# EasyEDA Pro project ZH_FLIGHT_H7B0.eprj, board PCB1
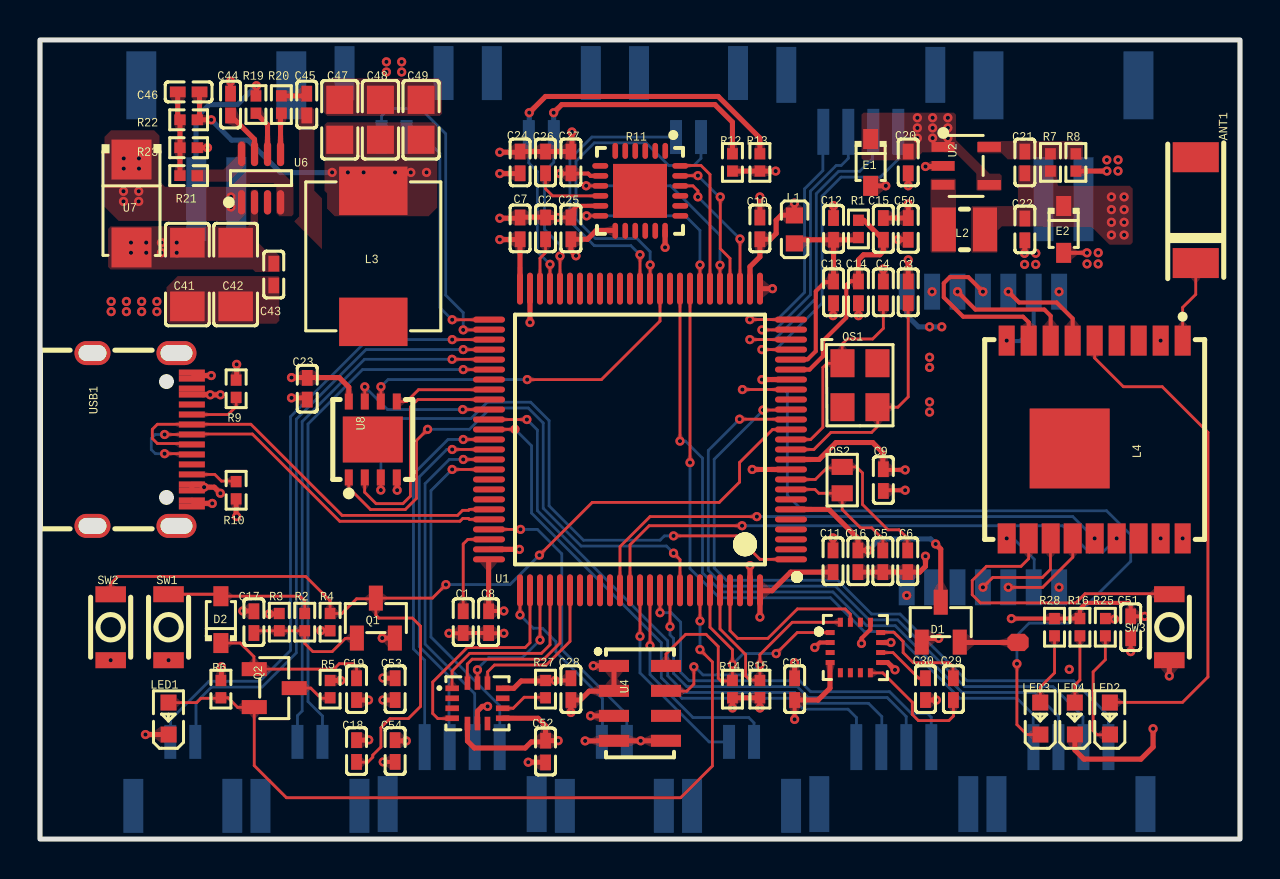
[diagram p4: board, top side]
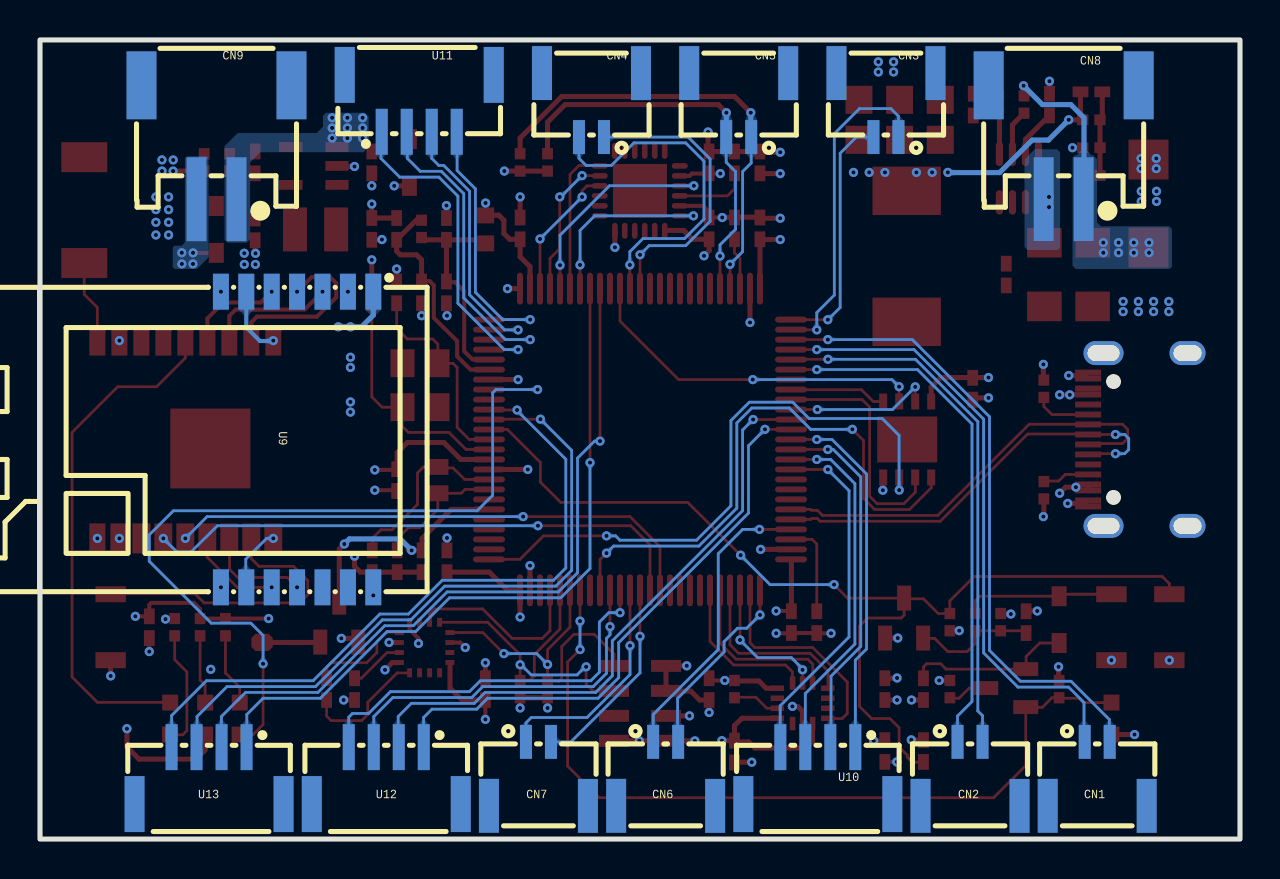
[diagram p5: board, bottom side, seen from below]

Outline 60 x 40 mm; copper layers: Top Layer, GND, PWR, Bottom Layer. Coordinates in mm from the lower left corner of the outline.
Outline path: rectangle 0,40 60,0
Stack: Top Layer 0.035mm / Dielectric1 0.48mm PP er 4.5 / GND 0.035mm / Dielectric2 0.48mm FR4 er 4.5 / PWR 0.035mm / Dielectric3 0.48mm PP er 4.5 / Bottom Layer 0.035mm

## Design rules (mm)
net VCC: PWR
net GND: PWR
net VDDA: PWR
net VREF: PWR
net VBAT: PWR
net VBAT_EXT: PWR
net +5V: PWR
net USB_D-: DP1
net USB_D+: DP1
net +12V: PWR
spacing safeClearance (default): track to track 0.152, other pairs 0.152 to 0.3
track width trackWidth (default): min 0.127, default 0.254, max 2.54
track width data: min 0.14, default 0.14, max 0.254
track width vcc: min 0.203, default 0.305, max 2.54
differential pair differentialPair (default): width min 0.127, default 0.254, max 2.54; gap min 0.152, default 0.152
via viaSize (default): diameter min 0.46, default 0.46, max 0.46; hole min 0.21, default 0.21, max 0.21
net class PWR uses vcc
net VCC uses vcc
net BOOT0 uses data
net $1N1678 uses data
net $1N1681 uses data
net 25M_OUT uses data
net 25M_IN uses data
net 32K_OUT uses data
net 32K_IN uses data
net GND uses vcc
net VDDA uses vcc
net VREF uses vcc
net RST uses data
net VBAT uses vcc
net VBAT_EXT uses vcc
net $1N8061 uses data
net $1N8406 uses data
net $1N8466 uses data
net $1N9525 uses data
net QSPI_BK1_NCS uses data
net QSPI_BK1_IO3 uses data
net QSPI_BK1_IO1 uses data
net QSPI_BK1_IO0 uses data
net QSPI_CLK uses data
net QSPI_BK1_IO2 uses data
net +5V uses vcc
net $1N12306 uses data
net $1N12347 uses data
net $1N18516 uses data
net USB_D- uses data
net USB_D+ uses data
net $1N18565 uses data
net $2N794 uses data
net IIC2_SDA uses data
net IIC2_SCL uses data
net $2N2599 uses data
net $2N2763 uses data
net $2N2588 uses data
net +12V uses vcc
net $3N1353 uses data
net $3N1354 uses data
net $3N1356 uses copperRegion1, data
net $3N1365 uses data
net $3N1361 uses data
net $3N1362 uses data
net $3N1363 uses data
net IIC1_SDA uses data
net IIC1_SCL uses data
net IIC1_EXIT uses data
net ELRS_NRST uses data
net ELRS_BUSY uses data
net ELRS_DIO1 uses data
net ELRS_RX uses data
net ELRS_TX uses data
net $4N1181 uses data
net ELRS_LED uses data
net $4N1470 uses data
net $4N1612 uses data
net ELRS_MOSI uses data
net ELRS_MISO uses data
net ELRS_NSS uses data
net ELRS_SCK uses data
net IMU2_CS uses data
net IMU2_MOSI uses data
net IMU2_MISO uses data
net IMU2_CLK uses data
net IMU2_EXIT uses data
net IMU1_EXIT uses data
net IMU1_MOSI uses data
net IMU1_MISO uses data
net IMU1_CLK uses data
net IMU1_CS uses data
net $2N4523 uses data
net PWM11 uses data
net PWM12 uses data
net EXTI3 uses data
net EXTI7 uses data
net SW_CLK uses data
net SW_DIO uses data
net PWM4 uses data
net PWM3 uses data
net PWM2 uses data
net PWM1 uses data
net PWM9 uses data
net PWM10 uses data
net UART3_RX uses data
net UART3_TX uses data
net UART1_RX uses data
net UART1_TX uses data
net UART5_TX uses data
net UART5_RX uses data
net UART7_TX uses data
net UART7_RX uses data
net ADC2_9 uses data
net ADC2_8 uses data
net PWM8 uses data
net PWM7 uses data
net PWM6 uses data
net PWM5 uses data
net ADC1_11 uses data
net ADC1_10 uses data

## Placement (name value [footprint] x y rotation side)
ANT1  CA-C03  [ANT-SMD_CA-C03]  57.79 31.48 270 top
C1  2.2uF  [C0402]  21.16 10.86 270 top
C2  2.2uF  [C0402]  25.28 30.57 270 top
C3  22pF  [C0402]  43.41 27.37 270 top
C4  22pF  [C0402]  42.17 27.37 270 top
C5  6pF  [C0402]  42.14 13.9 90 top
C6  6pF  [C0402]  43.39 13.9 90 top
C7  0.1uF  [C0402]  24.01 30.57 270 top
C8  0.1uF  [C0402]  22.43 10.86 90 top
C9  0.1uF  [C0402]  42.17 17.97 90 top
C10  0.1uF  [C0402]  35.99 30.57 270 top
C11  0.1uF  [C0402]  39.65 13.9 270 top
C12  10uF  [C0402]  39.68 30.54 270 top
C13  10uF  [C0402]  39.68 27.37 90 top
C14  10uF  [C0402]  40.92 27.37 90 top
C15  10uF  [C0402]  42.17 30.54 270 top
C16  0.1uF  [C0402]  40.9 13.9 90 top
C17  0.1uF  [C0402]  10.7 10.86 270 top
C18  0.1uF  [C0402]  15.83 4.41 270 top
C19  0.1uF  [C0402]  15.83 7.5 90 top
C20  10uF  [C0402]  43.41 33.87 90 top
C21  22pF  [C0402]  49.24 33.87 270 top
C22  10uF  [C0402]  49.24 30.52 90 top
C23  0.1uF  [C0402]  13.36 22.54 90 top
C24  0.1uF  [C0402]  24.01 33.87 270 top
C25  2.2uF  [C0402]  26.55 30.57 270 top
C26  0.47uF  [C0402]  25.28 33.87 270 top
C27  10nF  [C0402]  26.55 33.87 270 top
C28  0.1uF  [C0402]  26.55 7.5 270 top
C29  0.22uF  [C0402]  45.67 7.5 270 top
C30  4.7uF  [C0402]  44.27 7.5 270 top
C31  0.1uF  [C0402]  37.73 7.5 270 top
C41  N/A  [C1206]  7.37 28.26 90 top
C42  22uF  [C1206]  9.78 28.26 90 top
C43  0.1uF  [C0402]  11.69 28.26 90 top
C44  0.1uF  [C0402]  9.53 36.76 270 top
C45  0.1uF  [C0402]  13.34 36.76 270 top
C46  33pF  [C0402]  7.43 37.4 0 top
C47  22uF  [C0805]  14.99 36 270 top
C48  22uF  [C0805]  17.02 36 270 top
C49  N/A  [C0805]  19.05 36 270 top
C50  0.1uF  [C0402]  43.41 30.54 270 top
C51  0.1uF  [C0402]  54.53 10.6 270 top
C52  10nF  [C0402]  25.28 4.38 90 top
C53  0.1uF  [C0402]  17.76 7.5 270 top
C54  2.2uF  [C0402]  17.76 4.41 90 top
CN1  GH1.25-2PWBPZ  [CONN-SMD_GH1.25-2PWBPZ]  7.14 3.26 180 bottom
CN2  GH1.25-2PWBPZ  [CONN-SMD_GH1.25-2PWBPZ]  13.5 3.26 180 bottom
CN3  GH1.25-2PWBPZ  [CONN-SMD_GH1.25-2PWBPZ]  17.7 36.74 0 bottom
CN4  GH1.25-2PWBPZ  [CONN-SMD_GH1.25-2PWBPZ]  32.43 36.74 0 bottom
CN5  GH1.25-2PWBPZ  [CONN-SMD_GH1.25-2PWBPZ]  25.06 36.74 0 bottom
CN6  GH1.25-2PWBPZ  [CONN-SMD_GH1.25-2PWBPZ]  28.72 3.26 180 bottom
CN7  GH1.25-2PWBPZ  [CONN-SMD_GH1.25-2PWBPZ]  35.08 3.26 180 bottom
CN8  HDGC2001WR-S-2P  [CONN-SMD_2P-P2.00_HDGC_HDGC2001WR-S-2P]  8.82 34.88 0 bottom
CN9  HDGC2001WR-S-2P  [CONN-SMD_2P-P2.00_HDGC_HDGC2001WR-S-2P]  51.17 34.88 0 bottom
D1  BAT54C-KL3  [sot-23-3_l2.9-w1.3-p1.90-ls2.4-br]  45.04 10.86 270 top
D2  1N4148WS  [sod-323_l1.8-w1.3-ls2.5-rd]  9.04 10.98 90 top
E1  CESD5V0D3 ZA  [sod-323_l1.8-w1.3-ls2.5-rd]  41.53 33.87 270 top
E2  CESD3V3D3 YU  [sod-323_l1.8-w1.3-ls2.5-rd]  51.18 30.52 270 top
L1  SCBG160808U501T  [l0603]  37.72 30.52 270 top
L2  2.2uH  [ind-smd_l2.5-w2.0]  46.22 30.52 180 top
L3  4.7uH  [IND-SMD_L7.3-W6.6]  16.66 29.17 270 top
L4  ESP-01F-2M  [wifim-smd_esp-01f-2m]  52.73 20 270 top
LED1  -  [LED0603-RD_BLUE]  6.43 6.03 90 top
LED2  -  [LED0603-RD]  53.5 6.03 90 top
LED3  -  [LED0603-RD_BLUE]  50.01 6.03 90 top
LED4  -  [LED0603-RD]  51.74 6.03 90 top
NOREF  -  [Pad_e3197]  48.9 9.84 0 top
OS1  25MHz  [osc-smd_4p-l3.2-w2.5-bl]  41 22.72 270 top
OS2  32.768kHz  [osc-smd_2p-l1.6-w1.0]  40.11 17.97 270 top
Q1  SS8050  [sot-23-3_l2.9-w1.3-p1.90-ls2.4-br]  16.79 11.06 270 top
Q2  SS8050  [sot-23-3_l2.9-w1.3-p1.90-ls2.4-br]  11.71 7.55 180 top
R1  0R  [R0402]  40.92 30.54 270 top
R2  10K  [R0402]  13.24 10.86 270 top
R3  10K  [R0402]  11.97 10.86 270 top
R4  10K  [R0402]  14.51 10.86 270 top
R5  1K  [R0402]  14.51 7.5 90 top
R6  10K  [R0402]  9.04 7.5 270 top
R7  680K  [R0402]  50.52 33.87 270 top
R8  150K  [R0402]  51.79 33.87 90 top
R9  5.1K  [R0402]  9.81 22.54 90 top
R10  5.1K  [R0402]  9.81 17.46 90 top
R11  ICM-20689  [QFN-24_L4.0-W4.0-P0.50-TL-EP2.6]  30.01 32.45 270 top
R12  10K  [R0402]  34.62 33.87 90 top
R13  10K  [R0402]  35.99 33.87 90 top
R14  10K  [R0402]  34.62 7.5 90 top
R15  10K  [R0402]  35.99 7.5 90 top
R16  3K  [R0402]  52 10.6 270 top
R19  100K  [R0402]  10.8 36.77 270 top
R20  10R  [R0402]  12.07 36.76 90 top
R21  0R  [R0402]  7.43 33.21 180 top
R22  40.2K  [R0402]  7.43 36 0 top
R23  5.49K  [R0402]  7.43 34.61 180 top
R25  1K  [R0402]  53.27 10.6 90 top
R26  ICM-42688-P  [LGA-14_L3.0-W2.5-P0.50-TL]  21.87 6.8 0 top
R27  10K  [R0402]  25.28 7.5 90 top
R28  1K  [R0402]  50.73 10.6 270 top
SW1  K2-1827SQ-C3DW-06  [sw-smd_l3.0-w2.0-ls3.5]  6.43 10.6 90 top
SW2  K2-1827SQ-C3DW-06  [sw-smd_l3.0-w2.0-ls3.5]  3.53 10.6 270 top
SW3  K2-1827SQ-C3DW-06  [sw-smd_l3.0-w2.0-ls3.5]  56.47 10.6 270 top
U1  STM32H7B0VBT6  [lqfp-100_l14.0-w14.0-p0.50-ls16.0-bl]  30 20 90 top
U2  XT3410AFMR-G  [sot-23-5_l3.0-w1.7-p0.95-ls2.8-bl]  46.31 33.69 270 top
U4  MS5611-01BA03  [SENSORS-SMD_MS5611-01BA03]  30 6.79 270 top
U5  QMC5883L  [LGA-16_L3.0-W3.0-P0.50-BL_SQ]  40.77 9.59 270 top
U6  MP2225GJ  [TSOT-23-8_L2.9-W1.6-P0.65-LS2.8-BR]  11.05 33.08 270 top
U7  SMAJ12A  [SMA_L4.3-W2.6-LS5.2-RD]  4.57 31.81 270 top
U8  W25Q64JVXGIQ  [XSON-8_L4.0-W4.0-P0.80-TL-EP]  16.64 20 90 top
U9  E28-2G4M12S  [WIRELM-SMD_E28-2G4M12S]  47.15 20 270 bottom
U10  GH1.25-4PLTPZ  [CONN-SMD_4P-P1.25_GH1.25-4P]  21.11 3.17 180 bottom
U11  GH1.25-4PLTPZ  [CONN-SMD_4P-P1.25_GH1.25-4P]  41.04 36.83 0 bottom
U12  GH1.25-4PLTPZ  [CONN-SMD_4P-P1.25_GH1.25-4P]  42.69 3.17 180 bottom
U13  GH1.25-4PLTPZ  [CONN-SMD_4P-P1.25_GH1.25-4P]  51.55 3.17 180 bottom
USB1  TYPEC-304A-ACP16W  [usb-c_smd-type-c-31-m-12]  5.11 20 270 top

## Footprints (pads in the part's own frame, mm; a bottom-side part is the same pattern mirrored in y, then rotated)
ANT-SMD_CA-C03
  rect 1.501x2.301 smd: 1(-2.649,0) 2(2.649,0)
C0402
  rect 0.79x0.54 smd: 1(-0.545,0) 2(0.545,0)
C0805
  rect 1.41x1.35 smd: 1(-1,0) 2(1,0)
C1206
  rect 1.485x1.728 smd: 1(-1.593,0) 2(1.593,0)
CONN-SMD_2P-P2.00_HDGC_HDGC2001WR-S-2P
  rect 1x4.2 smd: 1(-1,2.85) 2(1,2.85)
  rect 1.5x3.4 smd: 3(3.75,-2.85) 4(-3.75,-2.85)
CONN-SMD_4P-P1.25_GH1.25-4P
  rect 0.6x2.3 smd: 1(1.875,1.425) 2(0.625,1.425) 3(-0.625,1.425) 4(-1.875,1.425)
  rect 1x2.8 smd: 5(-3.725,-1.425) 6(3.725,-1.425)
CONN-SMD_GH1.25-2PWBPZ
  rect 0.6x1.7 smd: 1(-0.625,1.602) 2(0.625,1.602)
  rect 1x2.7 smd: 3(2.475,-1.602) 4(-2.475,-1.598)
ind-smd_l2.5-w2.0
  rect 1.199x2.2 smd: 1(1.028,0) 2(-1.028,0)
IND-SMD_L7.3-W6.6
  rect 2.423x3.419 smd: 1(3.279,0) 2(-3.279,0)
l0603
  rect 0.8x0.864 smd: 1(-0.7,0) 2(0.7,0)
LED0603-RD
  rect 0.8x0.8 smd: 1(-0.799,-0.004) 2(0.799,0.004)
LED0603-RD_BLUE
  rect 0.8x0.8 smd: 1(-0.8,-0.003) 2(0.8,0.003)
LGA-14_L3.0-W2.5-P0.50-TL
  rect 0.675x0.28 smd: 1(-1.262,0.75) 2(-1.262,0.25) 3(-1.262,-0.25) 4(-1.262,-0.75) 8(1.262,-0.75) 9(1.262,-0.25) 10(1.262,0.25) 11(1.262,0.75)
  rect 0.28x0.675 smd: 5(-0.5,-1.012) 6(0,-1.012) 7(0.5,-1.012) 12(0.5,1.012) 13(0,1.012) 14(-0.5,1.012)
LGA-16_L3.0-W3.0-P0.50-BL_SQ
  rect 0.25x0.45 smd: 1(-0.75,-1.263) 2(-0.25,-1.263) 3(0.25,-1.263) 4(0.75,-1.263) 9(0.75,1.263) 10(0.25,1.263) 11(-0.25,1.263) 12(-0.75,1.263)
  rect 0.45x0.25 smd: 5(1.263,-0.75) 6(1.263,-0.25) 7(1.263,0.25) 8(1.263,0.75) 13(-1.263,0.75) 14(-1.263,0.25) 15(-1.263,-0.25) 16(-1.263,-0.75)
lqfp-100_l14.0-w14.0-p0.50-ls16.0-bl
  oval 0.3x1.6 smd: 1(-6,-7.55) 2(-5.5,-7.55) 3(-5,-7.55) 4(-4.5,-7.55) 5(-4,-7.55) 6(-3.5,-7.55) 7(-3,-7.55) 8(-2.5,-7.55) 9(-2,-7.55) 10(-1.5,-7.55) 11(-1,-7.55) 12(-0.5,-7.55) 13(0,-7.55) 14(0.5,-7.55) 15(1,-7.55) 16(1.5,-7.55) 17(2,-7.55) 18(2.5,-7.55) 19(3,-7.55) 20(3.5,-7.55) 21(4,-7.55) 22(4.5,-7.55) 23(5,-7.55) 24(5.5,-7.55) 25(6,-7.55) 51(6,7.55) 52(5.5,7.55) 53(5,7.55) 54(4.5,7.55) 55(4,7.55) 56(3.5,7.55) 57(3,7.55) 58(2.5,7.55) 59(2,7.55) 60(1.5,7.55) 61(1,7.55) 62(0.5,7.55) 63(0,7.55) 64(-0.5,7.55) 65(-1,7.55) 66(-1.5,7.55) 67(-2,7.55) 68(-2.5,7.55) 69(-3,7.55) 70(-3.5,7.55) 71(-4,7.55) 72(-4.5,7.55) 73(-5,7.55) 74(-5.5,7.55) 75(-6,7.55)
  oval 1.6x0.3 smd: 26(7.55,-6) 27(7.55,-5.5) 28(7.55,-5) 29(7.55,-4.5) 30(7.55,-4) 31(7.55,-3.5) 32(7.55,-3) 33(7.55,-2.5) 34(7.55,-2) 35(7.55,-1.5) 36(7.55,-1) 37(7.55,-0.5) 38(7.55,0) 39(7.55,0.5) 40(7.55,1) 41(7.55,1.5) 42(7.55,2) 43(7.55,2.5) 44(7.55,3) 45(7.55,3.5) 46(7.55,4) 47(7.55,4.5) 48(7.55,5) 49(7.55,5.5) 50(7.55,6) 76(-7.55,6) 77(-7.55,5.5) 78(-7.55,5) 79(-7.55,4.5) 80(-7.55,4) 81(-7.55,3.5) 82(-7.55,3) 83(-7.55,2.5) 84(-7.55,2) 85(-7.55,1.5) 86(-7.55,1) 87(-7.55,0.5) 88(-7.55,0) 89(-7.55,-0.5) 90(-7.55,-1) 91(-7.55,-1.5) 92(-7.55,-2) 93(-7.55,-2.5) 94(-7.55,-3) 95(-7.55,-3.5) 96(-7.55,-4) 97(-7.55,-4.5) 98(-7.55,-5) 99(-7.55,-5.5) 100(-7.55,-6)
osc-smd_2p-l1.6-w1.0
  rect 0.8x1.06 smd: 1(-0.66,0) 2(0.66,0)
osc-smd_4p-l3.2-w2.5-bl
  rect 1.4x1.2 smd: 1(-1.1,-0.875) 2(1.1,-0.875) 3(1.1,0.875) 4(-1.1,0.875)
Pad_e3197
  custom 1.067x0.863 smd: 1(0,0)
QFN-24_L4.0-W4.0-P0.50-TL-EP2.6
  oval 0.8x0.28 smd: 1(-2,1.25) 2(-2,0.75) 3(-2,0.25) 4(-2,-0.25) 5(-2,-0.75) 6(-2,-1.25) 13(2,-1.25) 14(2,-0.75) 15(2,-0.25) 16(2,0.25) 17(2,0.75) 18(2,1.242)
  oval 0.28x0.8 smd: 7(-1.25,-2) 8(-0.75,-2) 9(-0.25,-2) 10(0.25,-2) 11(0.75,-2) 12(1.25,-2) 19(1.25,2) 20(0.75,2) 21(0.25,2) 22(-0.25,2) 23(-0.75,2) 24(-1.25,2)
  rect 2.7x2.7 smd: 25(0,-0.013)
R0402
  rect 0.566x0.54 smd: 1(-0.433,0) 2(0.433,0)
SENSORS-SMD_MS5611-01BA03
  rect 0.6x1.5 smd: 1(-1.875,-1.3) 2(-0.625,-1.3) 3(0.625,-1.3) 4(1.875,-1.3) 5(1.875,1.3) 6(0.625,1.3) 7(-0.625,1.3) 8(-1.875,1.3)
SMA_L4.3-W2.6-LS5.2-RD
  rect 2x2 smd: 1(-2.2,0) 2(2.2,0)
sod-323_l1.8-w1.3-ls2.5-rd
  rect 1x0.75 smd: 1(-1.173,0) 2(1.173,0)
sot-23-3_l2.9-w1.3-p1.90-ls2.4-br
  rect 1.25x0.7 smd: 1(1,-0.95) 2(1,0.95) 3(-1,0)
sot-23-5_l3.0-w1.7-p0.95-ls2.8-bl
  rect 0.49x1.157 smd: 1(-0.95,-1.153) 2(0,-1.153) 3(0.95,-1.153)
  rect 0.49x1.175 smd: 4(0.95,1.153) 5(-0.95,1.153)
sw-smd_l3.0-w2.0-ls3.5
  rect 0.8x1.524 smd: 1(-1.651,0) 2(1.651,0)
TSOT-23-8_L2.9-W1.6-P0.65-LS2.8-BR
  oval 1.222x0.363 smd: 1(1.212,-0.976) 2(1.212,-0.325) 3(1.212,0.325) 4(1.212,0.976) 5(-1.212,0.976) 6(-1.212,0.325) 7(-1.212,-0.325) 8(-1.212,-0.976)
usb-c_smd-type-c-31-m-12
  oval 1.2x2 hole 0.8x1.6: 0(-4.325,1.716) 1(4.325,1.716)
  oval 1.2x1.8 hole 0.8x1.4: 2(4.325,-2.484) 3(-4.325,-2.484)
  rect 0.3x1.3 smd: A1(-3.35,2.484) A4(-2.55,2.484) A5(-1.25,2.484) A6(-0.25,2.484) A7(0.25,2.484) A8(1.25,2.484) A9(2.55,2.484) A12(3.35,2.484) B1(3.05,2.484) B4(2.25,2.484) B5(1.75,2.484) B6(0.75,2.484) B7(-0.75,2.484) B8(-1.75,2.484) B9(-2.25,2.484) B12(-3.05,2.484)
wifim-smd_esp-01f-2m
  rect 1.501x0.8 smd: 1(-4.95,4.399) 2(-4.95,3.3) 3(-4.95,2.2) 4(-4.95,1.1) 5(-4.95,0) 6(-4.95,-1.1) 7(-4.95,-2.2) 8(-4.95,-3.3) 9(-4.95,-4.399) 18(4.95,4.399)
  rect 1.501x0.899 smd: 10(4.95,-4.399) 11(4.95,-3.3) 12(4.95,-2.2) 13(4.95,-1.1) 14(4.95,0) 15(4.95,1.1) 16(4.95,2.2) 17(4.95,3.3)
  rect 4x4 smd: 19(0.45,-1.25)
WIRELM-SMD_E28-2G4M12S
  rect 1.801x0.8 smd: 1(-7.399,3.81) 2(-7.399,2.54) 3(-7.399,1.27) 4(-7.399,0) 5(-7.399,-1.27) 6(-7.399,-2.54) 7(-7.399,-3.81) 8(7.399,-3.81) 9(7.399,-2.54) 10(7.399,-1.27) 11(7.399,0) 12(7.399,1.27) 13(7.399,2.54) 14(7.399,3.81)
XSON-8_L4.0-W4.0-P0.80-TL-EP
  rect 0.8x0.4 smd: 1(-1.9,1.2) 2(-1.9,0.4) 3(-1.9,-0.4) 4(-1.9,-1.2) 5(1.9,-1.2) 6(1.9,-0.4) 7(1.9,0.4) 8(1.9,1.2)
  rect 2.3x3 smd: 9(0,0)

## Nets
As in the schematic, except:
VBAT_EXT: D1.2 NOREF.1

Pads without a net: ANT1 1; L4 3 4 16 19; OS1 2 4; R11 1 2 3 4 5 6 7 14 15 16 17 19 20 21 25; R26 2 3 7 10; U1 2 3 4 5 7 17 35 39 40 41 42 43 44 45 57 67 68 69 82 83 84 85 93 98; U4 6; U5 3 5 6 7 14; U8 9; U9 12 13; USB1 A8 B8

## Via types
v1: diameter 0.46, hole 0.21, Top Layer to Bottom Layer, 245 vias

## Routing (per net, layer and track width the routed paths; a pad name or vN(x,y) marks a point on that pad's centre or on a via; arc(x,y) is an arc through that point)
+5V: length 12.6
  Top Layer w0.254: v1(9.02,17.31) 8.71,17.61 v1(8.21,17.61) 8.07,17.75 USB1.B4 USB1.A9 ; C46.2 7.98,36.27 arc(7.95,36.13) R22.2 v1(8.56,36) ; v1(9.02,22.24) v1(8.51,22.24) 8.5,22.25 USB1.B9
  Bottom Layer w0.254: v1(8.56,36) 9.58,34.99 10.39,34.99 12.02,33.36 14.6,33.36 v1(14.61,33.37)
  vias: v1(15.39,33.37) v1(16.18,33.37) v1(17.75,33.37) v1(18.54,33.37) v1(19.33,33.37) v1(43.87,36.1) v1(43.87,35.6) v1(43.87,35.09) v1(44.63,36.1) v1(44.63,35.6) v1(44.63,35.09) v1(45.39,36.1) v1(45.39,35.6) v1(45.39,35.09)
+12V: length 8.3
  Top Layer w0.254: v1(10.82,37.71) 10.82,37.2
  Bottom Layer w0.254: 7.82,32.03 7.8,32.05 7.8,36.1 8.46,36.76 9.88,36.76 v1(10.82,37.71)
  vias: v1(4.55,29.86) v1(4.55,29.35) v1(5.31,29.86) v1(5.31,29.35) v1(6.07,29.86) v1(6.07,29.35) v1(6.83,29.86) v1(6.83,29.35)
GND: length 74
  Top Layer w0.203: C54.1 v1(17.16,3.86) ; v1(20.45,10.3) 21.15,10.3 C1.2 C8.1 22.44,10.3 v1(23.19,10.3) ; v1(25.89,31.11) C25.1 26.55,31.4 26.84,31.7 R11.11 ; v1(43.26,17.46) 42.2,17.46 C9.1 ; v1(53.72,11.01) 53.7,11.04 R25.2 ; C51.2 54.54,10.06 v1(54.54,9.38) ; 25.28,7.94 v1(25.76,7.94) 26.43,7.94 C28.1 ; 52.35,29.35 v1(52.35,29.34) E2.2
  Top Layer w0.254: v1(39.65,15.07) C11.1 ; U5.9 42.38,8.84 v1(42.75,8.47) ; C44.1 v1(9.53,37.93) ; C18.1 16.42,4.95 v1(16.44,4.96) ; U1.99 v1(35.5,13.69) ; 9.04,7.94 9.07,7.96 v1(9.07,8.62) ; R9.2 9.83,23 v1(9.83,23.76) ; 24.01,34.36 23.99,34.38 v1(22.99,34.38) ; C16.1 C5.1 C6.1 43.98,13.36 44.27,13.65 v1(44.27,14.16) ; C23.1 13.27,22.08 v1(12.58,22.08) ; v1(43.41,32.7) C20.1 ; C10.1 v1(35.99,32.14) ; C12.1 v1(39.68,31.71) ; v1(36.1,23) 36.1,23 U1.19 ; C7.1 23.97,31.08 v1(22.99,31.08) ; v1(9.83,16.14) 9.81,16.17 9.81,17.03 ; 26.57,34.39 26.6,34.41 v1(26.6,35.39) ; U4.3 v1(27.53,6.17) ; R23.1 v1(8.38,34.61) ; C30.2 v1(44.82,6.96) ; LED1.1 v1(5.27,5.23) ; R8.1 v1(53.34,33.44) ; LED4.1 51.75,4.45 52.2,4 55.04,4 55.65,4.61 v1(55.65,5.52) ; U1.74 v1(23.97,14.5) ; C27.1 C26.1 C24.1 ; U1.26 v1(36.62,27.55) ; R11.18 v1(31.25,29.62) ; U1.10 v1(35.61,18.5) ; v1(43.41,31.79) C50.1 C15.1 ; v1(43.41,28.99) C3.1 ; USB1.B12 7.74,23.2 8.56,23.2 ; 42.29,32.7 v1(42.29,32.7) E1.2 ; 24.04,31.13 25.26,31.13 C2.1 v1(25.89,31.11) ; v1(27.26,4.91) 28.7,4.91 U4.4 v1(30.03,4.92) U4.5 ; 25.28,7.94 25.25,7.91 24.06,7.91 23.69,7.55 R26.11 ; C22.1 49.24,29.34 v1(49.23,29.32) ; v1(42.17,28.53) C4.1 ; U1.49 v1(24.5,25.86) ; C53.1 17.16,8.05 v1(17.15,8.06) ; v1(16.43,6.96) C19.1 ; USB1.B1 7.74,16.8 v1(8.61,16.8) ; U5.11 42.54,9.84 v1(42.55,9.84) ; v1(22.38,6.64) 22.11,6.64 21.87,6.4 R26.6 ; v1(10.14,11.42) 10.68,11.42 C17.1 ; v1(39.65,26.2) 39.65,26.8 C13.1 ; v1(40.92,26.2) C14.1 ; C52.1 25.26,3.85 v1(24.41,3.85) ; R3.1 11.94,11.26 v1(11.46,11.26) ; SW3.2 v1(56.47,8.16) ; v1(44.27,33.67) 45.12,33.67 U2.2 ; v1(17.86,17.46) 17.86,18.08 U8.4 ; v1(17.11,10.06) Q1.2 ; C31.1 v1(37.73,8.83)
  vias: v1(3.53,8.95) v1(3.56,26.91) v1(3.56,26.4) v1(4.19,34.07) v1(4.19,33.56) v1(4.17,32.43) v1(4.17,31.92) v1(4.32,26.91) v1(4.32,26.4) v1(4.95,34.07) v1(4.95,33.56) v1(4.94,32.43) v1(4.94,31.92) v1(5.08,26.91) v1(5.08,26.4) v1(5.84,26.91) v1(5.84,26.4) v1(8.56,23.2) v1(9.55,32.14) v1(9.55,31.63) v1(17.32,38.9) v1(17.32,38.4) v1(18.08,38.9) v1(18.08,38.4) v1(43.34,12.19) v1(44.48,24.12) v1(44.48,23.61) v1(44.48,21.88) v1(44.48,21.37) v1(44.6,27.4) v1(49.23,28.76) v1(49.79,29.32) v1(49.79,28.76) v1(50.96,27.4) v1(50.96,12.6) v1(51.46,8.49) v1(52.35,28.79) v1(52.91,29.35) v1(52.91,28.79) v1(53.34,33.99) v1(53.9,34) v1(53.9,33.44) v1(56.03,24.95) v1(57.13,15.05)
VBAT: length 12
  Top Layer w0.254: U1.6 39.44,16.5 40.9,15.05 C16.2 v1(41.42,14.45) 41.59,14.45 ; D1.3 45.04,14.51 v1(44.78,14.77)
  Bottom Layer w0.254: v1(44.78,14.77) 44.53,15.02 41.99,15.02 v1(41.42,14.45)
VBAT_EXT: length 2.9
  Top Layer w0.254: NOREF.1 46,9.84 D1.2
VCC: length 75.1
  Top Layer w0.203: R11.8 27.52,33.2 27.41,33.31 26.56,33.31 C27.2 26.53,33.31 v1(25.99,33.31) ; v1(23.19,11.42) 22.44,11.42 C8.2 ; v1(38.74,9.59) 38.99,9.84 U5.2 ; C9.2 42.2,18.48 v1(43.26,18.48) ; v1(55.23,11.15) C51.1 54.54,11.15 54.54,11.72 54.43,11.82 52.3,11.82 52,11.52 R16.1 R28.1 v1(48.57,11.04) ; U5.13 41.52,10.49 41.07,10.04 v1(41.07,9.79) ; C31.2 v1(37.73,5.99)
  Top Layer w0.254: v1(34.62,6.56) R14.1 R15.1 v1(35.99,6.56) ; 23.95,29.97 24,29.93 U1.50 ; C54.2 17.79,4.91 v1(18.32,4.91) ; C52.2 25.21,4.86 24.56,4.86 24.26,4.56 21.72,4.56 21.37,4.9 R26.5 ; C52.2 v1(25.91,4.92) ; C52.2 25.28,5.68 24.91,6.05 R26.8 ; C50.2 43.4,30.01 v1(42.9,30.01) ; v1(22.99,30.01) 23.99,30.01 C7.2 ; R11.13 28.74,30.47 27.82,30.47 27.37,30.02 C25.2 26.55,29.45 v1(26.8,29.2) ; v1(14.04,10.43) 14.5,10.43 R4.2 ; U1.75 22.43,13.98 C8.2 ; v1(35.99,11.11) 36,11.12 U1.100 36.02,12.43 36.6,12.43 37.53,13.36 C11.2 ; v1(36.78,33.44) R13.1 R12.1 ; U5.4 39.5,8.83 39.5,7.55 38.9,6.96 C31.2 ; v1(27.66,8.67) 28.69,8.67 U4.1 U4.2 28.69,7.4 27.46,7.4 27.02,6.96 C28.2 v1(26.55,6.34) ; v1(17.15,6.96) C53.2 ; C9.2 42.14,18.54 42.14,19.34 41.63,19.85 39.8,19.85 38.96,19 U1.11 ; 14.51,7.94 v1(15.04,7.94) ; U8.8 15.44,22.62 14.96,23.1 13.38,23.1 C23.2 13.35,23.1 v1(12.58,23.1) ; v1(37.72,31.84) L1.1 37.71,31.23 37.06,31.23 36.81,30.97 36.81,30.31 36.52,30.02 C10.2 35.99,29.14 35.5,28.65 U1.27 ; v1(44.94,10.04) 44.27,10.04 44.09,9.86 ; v1(22.99,33.31) 23.99,33.31 C24.2
  Bottom Layer w0.254: U9.1 43.34,26.22 43.92,25.64 v1(44.48,25.64) v1(45.09,25.64)
  vias: v1(6.43,8.95) v1(53.57,32.14) v1(53.57,31.51) v1(53.57,30.87) v1(53.57,30.24) v1(54.21,32.14) v1(54.21,31.51) v1(54.21,30.87) v1(54.21,30.24) v1(56.03,15.05)
VDDA: length 10.9
  Top Layer w0.203: U1.21 37.56,24.01 38.38,24.01 38.79,24.42 38.79,27.42 39.25,27.87 39.64,27.87 C13.2
  Top Layer w0.254: L1.2 37.9,30 C12.2 ; C12.2 40.81,30 R1.2 ; C12.2 C13.2
25M_IN: length 12.2
  Top Layer w0.14: C3.2 43.41,22.13 42.89,21.62 OS1.3 41.89,21.6 41.89,20.66 41.58,20.36 39.55,20.36 38.69,19.5 U1.12
25M_OUT: length 10.5
  Top Layer w0.14: U1.13 38.53,20 39.14,20.61 39.14,23.61 39.35,23.81 40.12,23.81 OS1.1 40.11,23.83 40.11,24.78 40.36,25.03 41.63,25.03 42.17,25.56 C4.2
32K_IN: length 6.7
  Top Layer w0.14: C5.2 42.14,15.02 41.58,15.58 41.02,15.58 40.11,16.5 OS2.2 ; 40.11,17.31 38.94,17.31 38.75,17.5 U1.8
32K_OUT: length 9.1
  Top Layer w0.14: U1.9 38.77,18 39.35,18.58 40.06,18.58 OS2.1 40.82,18.63 41.12,18.32 41.12,16.75 42.4,15.48 42.95,15.48 43.36,15.07 43.36,14.48 C6.2
ADC1_10: length 34.1
  Top Layer w0.14: U1.15 37.53,21.02 v1(34.98,21.02)
  Bottom Layer w0.14: U13.3 52.15,4.62 52.15,6.13 50.65,7.63 46.22,7.63 42.88,10.97 41.46,10.97 39.77,12.66 34.2,12.66 33.42,13.45 33.42,19.45 v1(34.98,21.02)
ADC1_11: length 34.7
  Top Layer w0.14: v1(36.15,21.47) 37.52,21.47 U1.16
  Bottom Layer w0.14: v1(36.15,21.47) 36.15,21.45 33.71,19.01 33.71,13.57 34.33,12.95 39.89,12.95 41.58,11.26 43,11.26 46.34,7.92 51.68,7.92 53.42,6.18 53.42,4.6 U13.4
ADC2_8: length 35.8
  Top Layer w0.14: v1(32.5,18.84) U1.33
  Bottom Layer w0.14: v1(32.5,18.84) 32.5,13.54 33.96,12.08 39.53,12.08 41.21,10.39 42.64,10.39 45.98,7.05 48.85,7.05 49.66,6.23 49.66,4.61 U13.1
ADC2_9: length 37.2
  Top Layer w0.14: v1(32,19.92) U1.34
  Bottom Layer w0.14: v1(32,19.92) 32.27,19.92 33.12,19.07 33.12,13.33 34.08,12.37 39.65,12.37 41.34,10.68 42.76,10.68 46.1,7.34 49.72,7.34 50.93,6.13 50.93,4.61 U13.2
BOOT0: length 40.8
  Top Layer w0.14: 33,10.91 v1(33,10.91) U1.94 ; LED1.2 7.84,6.83 8.05,7.05 9.02,7.05 R6.2 9.4,7.07 9.88,6.59 10.7,6.59 Q2.2 10.71,3.68 12.32,2.07 32.03,2.07 33.62,3.66 33.62,8.86 v1(33,9.49)
  Bottom Layer w0.14: v1(33,9.49) 33,9.49 v1(33,10.91)
ELRS_BUSY: length 4.8
  Top Layer w0.14: 51.63,15.05 51.64,15.04 51.64,14.11 50.13,12.6 v1(48.41,12.6)
ELRS_DIO1: length 5.3
  Top Layer w0.14: v1(47.15,12.6) 47.64,13.09 50.12,13.09 50.52,13.5 50.52,15.04 L4.12
ELRS_LED: length 25.8
  Top Layer w0.14: L4.5 52.73,24.08 54.17,22.64 56.11,22.64 58.4,20.36 58.4,8.11 57.13,6.84 53.5,6.84 LED2.2
ELRS_MISO: length 6.4
  Top Layer w0.203: v1(45.88,27.4) 46.77,26.5 50.22,26.5 50.53,26.19 L4.7
ELRS_MOSI: length 8.8
  Top Layer w0.203: L4.8 49.43,25.87 49.15,26.15 46.15,26.15 45.19,27.11 45.19,27.82 45.49,28.13 46.41,28.13 v1(47.15,27.4)
ELRS_NRST: length 3.2
  Bottom Layer w0.14: U9.9 49.71,12.63 49.71,14.01 48.67,15.05 v1(48.33,15.05)
ELRS_NSS: length 3.4
  Bottom Layer w0.203: v1(48.33,24.95) 48.36,24.93 49,24.93 49.69,25.61 U9.6
ELRS_RX: length 27
  Top Layer w0.14: v1(35.84,16.14) 30.5,16.14 29,14.64 U1.86
  Bottom Layer w0.14: v1(35.84,16.14) 51.64,16.14 v1(52.73,15.05)
ELRS_SCK: length 4.9
  Top Layer w0.203: 51.63,24.95 51.63,26.05 50.83,26.86 48.96,26.86 v1(48.41,27.4)
ELRS_TX: length 27.8
  Top Layer w0.14: v1(35.1,15.68) 30.46,15.68 29.5,14.73 U1.87
  Bottom Layer w0.14: v1(35.1,15.68) 51.13,15.68 52.45,14.36 53.15,14.36 v1(53.83,15.05)
EXTI3: length 11.4
  Top Layer w0.14: v1(30.5,9.68) U1.89
  Bottom Layer w0.14: CN7.1 35.7,5.81 35.44,6.08 32.65,6.08 30.5,8.23 v1(30.5,9.68)
EXTI7: length 10
  Top Layer w0.14: v1(30,10.15) U1.88
  Bottom Layer w0.14: v1(30,10.15) 30,8.32 33.45,4.86 34.45,4.86
IIC1_EXIT: length 9.3
  Top Layer w0.14: U5.15 40.52,11.26 40.26,11.52 37.87,11.52 36.39,10.04 34.88,10.04 34.5,10.43 U1.97
IIC1_SCL: length 16.8
  Top Layer w0.14: U1.95 33.5,10.6 34.62,9.48 v1(34.62,8.74) 34.62,7.94 34.6,7.91 34.05,7.91 33.91,8.05 33.91,9.64 33.3,10.25 32.29,10.25 31.3,9.26 U4.8 ; U5.1 37.86,10.34 v1(36.81,9.28)
  Bottom Layer w0.14: v1(36.81,9.28) 35.17,9.28 v1(34.62,8.74)
IIC1_SDA: length 17.7
  Top Layer w0.14: v1(32.69,8.62) 32.69,7.76 32.34,7.4 31.31,7.4 U4.7 ; U5.16 37.61,10.85 35.99,9.23 v1(35.99,8.72) 35.99,7.94 35.97,7.96 35.49,7.96 35.28,8.16 35.28,9.23 34,10.51 U1.96
  Bottom Layer w0.14: 35.99,8.77 35.44,8.22 33.15,8.22 32.69,8.67
IIC2_SCL: length 20.4
  Top Layer w0.14: v1(26,29.18) U1.46
  Top Layer w0.254: v1(25.68,36.36) 26.09,36.76 33.74,36.76 34.62,35.89 R12.2
  Bottom Layer w0.14: v1(26,29.18) 26,29.74 25.22,30.52 25.22,33.41 25.69,33.88 CN5.2
  Bottom Layer w0.254: CN5.2 25.68,35.15 v1(25.68,36.36)
IIC2_SDA: length 22.8
  Top Layer w0.14: U1.47 v1(25.5,28.77)
  Top Layer w0.254: R13.2 35.99,35.09 33.91,37.17 25.28,37.17 v1(24.46,36.36)
  Bottom Layer w0.14: v1(25.5,28.77) 24.87,29.4 24.87,33.41 24.44,33.84 CN5.1
  Bottom Layer w0.254: v1(24.46,36.36) 24.46,35.16 CN5.1
IMU1_CLK: length 7.2
  Top Layer w0.14: v1(34.01,32.14) 34.01,29.55 34.5,29.06 U1.29 ; R11.23 32.03,33.21 v1(32.9,33.21)
  Bottom Layer w0.14: v1(32.9,33.21) 33.96,32.14 v1(34.01,32.14)
IMU1_CS: length 6.8
  Top Layer w0.14: v1(35,30.04) U1.28 ; R11.22 32.65,32.7 32.9,32.45 v1(32.9,32.14)
  Bottom Layer w0.14: v1(35,30.04) v1(32.9,32.14)
IMU1_EXIT: length 9.6
  Top Layer w0.14: U1.32 v1(33,28.74) ; v1(27.33,31.2) R11.12
  Bottom Layer w0.14: v1(27.33,31.2) 32.27,31.2 33,30.47 33,28.74 v1(33,28.74)
IMU1_MISO: length 11.1
  Top Layer w0.14: R11.9 28.01,32.7 v1(27.31,32.7) ; U1.30 v1(34,28.73)
  Bottom Layer w0.14: v1(34,28.73) 34,30.22 31.52,32.7 v1(27.31,32.7)
IMU1_MOSI: length 7.4
  Top Layer w0.14: U1.31 33.5,33.26 33.05,33.72 32.03,33.72 R11.24
IMU2_CLK: length 6.9
  Top Layer w0.14: R26.13 v1(21.87,8.47) ; U1.78 v1(25,9.96)
  Bottom Layer w0.14: v1(25,9.96) 24.12,9.08 22.43,9.08 21.87,8.52 v1(21.87,8.47)
IMU2_CS: length 7.9
  Top Layer w0.14: R26.12 22.38,7.82 22.38,8.37 22.72,8.71 25.31,8.71 26.5,9.9 U1.81
IMU2_EXIT: length 11
  Top Layer w0.14: R26.4 20.6,6.03 19.89,6.03 19.64,6.28 19.64,7.86 21.36,9.59 24.26,9.59 24.5,9.83 U1.77
IMU2_MISO: length 9
  Top Layer w0.14: U1.79 25.5,9.72 25.07,9.29 21.49,9.29 20.6,8.41 20.6,7.55 R26.1
IMU2_MOSI: length 8.7
  Top Layer w0.14: U1.80 26,9.81 25.19,9 21.61,9 21.36,8.76 21.36,7.82 R26.14
LED: length 42.3
  Top Layer w0.14: U1.18 v1(35.12,22.5) ; LED3.1 49.34,5.23 48.85,5.73 v1(48.85,8.77)
  Bottom Layer w0.14: v1(48.85,8.77) 48.85,10.2 49.46,10.81 51.44,10.81 54.54,13.9 54.54,15.23 53.33,16.43 38.14,16.43 37.37,17.21 37.37,22.34 37.2,22.5 v1(35.12,22.5)
PWM1: length 18.4
  Top Layer w0.14: U1.63 v1(21.16,20)
  Bottom Layer w0.14: v1(21.16,20) 20.4,20 18.67,18.27 18.67,9.52 19.23,8.95 U10.1
PWM2: length 18.2
  Top Layer w0.14: U1.64 v1(20.61,19.5)
  Bottom Layer w0.14: v1(20.61,19.5) 20.34,19.5 18.96,18.13 18.96,9.64 20.45,8.15 20.45,4.63 U10.2
PWM3: length 17.9
  Top Layer w0.14: U1.65 v1(21.16,19)
  Bottom Layer w0.14: v1(21.16,19) 20.47,19 19.26,17.79 19.26,9.76 21.73,7.28 21.73,4.6
PWM4: length 17.6
  Top Layer w0.14: U1.66 v1(20.61,18.5)
  Bottom Layer w0.14: U10.4 22.99,4.61 22.99,6.67 19.55,10.11 19.55,17.44 v1(20.61,18.5)
PWM5: length 16.8
  Top Layer w0.14: v1(36.1,24.5) U1.22
  Bottom Layer w0.14: U11.1 42.95,35.36 42.95,34.07 42.01,33.13 40.05,33.13 39.11,32.19 39.11,26.82 36.79,24.5 v1(36.1,24.5)
PWM6: length 16.4
  Top Layer w0.14: v1(35.49,25) U1.23
  Bottom Layer w0.14: U11.2 41.63,35.37 41.63,34.07 40.99,33.42 39.93,33.42 38.81,32.31 38.81,27.09 36.73,25 v1(35.49,25)
PWM7: length 13.7
  Top Layer w0.14: U1.24 37.54,25.49 v1(36.1,25.49)
  Bottom Layer w0.14: v1(36.1,25.49) 36.76,25.49 38.52,27.25 38.52,32.43 39.81,33.72 40.06,33.72 40.41,34.07 U11.3
PWM8: length 13.8
  Top Layer w0.14: v1(35.49,26) U1.25
  Bottom Layer w0.14: v1(35.49,26) 36.86,26 38.23,27.37 38.23,32.55 39.14,33.46 39.14,35.38 U11.4
PWM9: length 28.8
  Top Layer w0.14: v1(23.75,20.51) 22.46,20.51 U1.62
  Bottom Layer w0.14: U12.1 40.82,4.61 40.82,6.08 40.4,6.5 38.17,6.5 37.62,7.05 32.1,7.05 31.07,8.08 31.07,9.83 24.58,16.32 24.58,19.68 v1(23.75,20.51)
PWM10: length 30.7
  Top Layer w0.14: v1(24.34,21) U1.61
  Bottom Layer w0.14: U12.2 42.09,4.63 42.09,6.13 41.43,6.79 38.29,6.79 37.74,7.34 32.22,7.34 31.38,8.17 31.38,9.92 24.87,16.44 24.87,20.48 v1(24.34,21)
PWM11: length 18.3
  Top Layer w0.14: v1(31.5,10.63) U1.91
  Bottom Layer w0.14: v1(31.5,10.63) 31.5,10.22 31.68,10.04 31.68,8.29 32.34,7.63 37.86,7.63 38.41,7.08 42.36,7.08 43.31,6.13 43.31,4.6 U12.3
PWM12: length 19.8
  Top Layer w0.14: v1(31,11.33) U1.90
  Bottom Layer w0.14: v1(31,11.33) 31.56,11.33 32.03,10.86 32.03,8.35 32.46,7.92 37.98,7.92 38.53,7.38 42.48,7.38 43.57,6.28 44.38,6.28 44.56,6.1 U12.4
QSPI_BK1_IO0: length 4.9
  Top Layer w0.14: U1.58 22.44,22.49 18.93,22.49 18.34,21.9 U8.5
QSPI_BK1_IO1: length 12
  Top Layer w0.14: U1.59 18.89,22 18.52,21.63 18.52,17.16 18.14,16.79 16.8,16.79 16.23,17.36 16.23,18.09 U8.2
QSPI_BK1_IO2: length 30.5
  Top Layer w0.14: v1(31.68,15.17) 34.83,15.17 36,14 U1.1 ; U8.3 v1(17.04,17.47)
  Bottom Layer w0.14: v1(31.68,15.17) 31.22,15.17 31,14.96 27.17,14.96 25.45,16.68 25.45,20.95 24.53,21.87 22.37,21.87 21.55,21.05 17.89,21.05 17.05,20.2 17.05,17.47 v1(17.04,17.47)
QSPI_BK1_IO3: length 7.4
  Top Layer w0.14: v1(21.14,21.5) U1.60 ; U8.7 v1(16.24,22.64)
  Bottom Layer w0.14: v1(21.14,21.5) 17.38,21.5 v1(16.24,22.64)
QSPI_BK1_NCS: length 28.5
  Top Layer w0.14: U8.1 15.44,17.58 16.53,16.5 18.26,16.5 18.82,17.05 18.82,19.95 v1(19.38,20.51) ; v1(31.68,14.31) 32,13.99 U1.92
  Bottom Layer w0.14: v1(31.68,14.31) 31.32,14.67 27.05,14.67 25.16,16.56 25.16,20.83 24.41,21.58 22.53,21.58 21.47,20.51 v1(19.38,20.51)
QSPI_CLK: length 17.7
  Top Layer w0.14: v1(17.05,22.64) 17.05,21.91 U8.6 ; U1.36 31,25.93 28.07,23 v1(24.36,23)
  Bottom Layer w0.14: v1(24.36,23) 17.4,23 v1(17.05,22.64)
RST: length 52.5
  Top Layer w0.14: v1(20.3,12.74) 19.62,12.06 Q1.3 ; Q1.3 16.76,12.03 15.83,12.03 15.09,11.29 R4.1 14.51,11.92 13.29,13.14 3.89,13.14 3.53,12.79 SW2.1 ; Q1.3 16.79,11.21 16.94,11.06 18.62,11.06 19.03,10.65 19.03,6.64 18.42,6.03 17.5,6.03 17.05,5.57 17.05,4.61 16.64,4.2 16.64,4.1 16.39,3.85 15.84,3.85 C18.2 ; U1.14 36.63,20.5 34.98,18.85 34.98,17.87 33.96,16.85 27.61,16.85 v1(24.97,14.21)
  Bottom Layer w0.14: v1(20.3,12.74) 23.5,12.74 v1(24.97,14.21)
SW_CLK: length 9.6
  Top Layer w0.14: U1.76 v1(24,11.22)
  Bottom Layer w0.14: v1(24,11.22) 24.67,10.55 25.12,10.55 25.8,9.88 25.8,9.36 28.12,7.04 28.12,4.89 CN6.2
SW_DIO: length 14.9
  Top Layer w0.14: U1.72 v1(24.03,15.5)
  Bottom Layer w0.14: v1(24.03,15.5) 24.87,15.5 26.09,14.28 26.09,9.49 29.34,6.23 29.34,4.87 CN6.1
UART1_RX: length 30.8
  Top Layer w0.14: U1.54 v1(21.16,24.5)
  Bottom Layer w0.14: CN1.1 7.8,4.9 7.8,6.84 8.57,7.61 11.1,7.61 12.82,9.32 12.82,21.02 16.3,24.5 v1(21.16,24.5)
UART1_TX: length 31.8
  Top Layer w0.14: U1.53 20.62,25
  Bottom Layer w0.14: v1(20.61,25) 16.39,25 12.52,21.14 12.52,9.44 10.98,7.9 8.45,7.9 6.53,5.98 6.53,4.88 CN1.2
UART3_RX: length 26.4
  Top Layer w0.14: U1.56 v1(21.16,23.5)
  Bottom Layer w0.14: CN2.1 14.12,6.16 13.4,6.88 13.4,20.78 16.13,23.5 v1(21.16,23.5)
UART3_TX: length 26.8
  Top Layer w0.14: v1(20.6,24.01) 22.44,24.01 U1.55
  Bottom Layer w0.14: v1(20.6,24.01) 16.23,24.01 13.11,20.9 13.11,6.41 12.87,6.18 CN2.2
UART5_RX: length 12.4
  Top Layer w0.14: v1(20.61,26) 22.44,26 U1.51
  Bottom Layer w0.14: v1(20.61,26) 20.6,26 19.99,26.6 19.99,34.33 19.18,35.14 CN3.2
UART5_TX: length 16.4
  Top Layer w0.14: U1.52 22.44,25.49 v1(21.16,25.49)
  Bottom Layer w0.14: v1(21.16,25.49) 21.16,26.35 20.28,27.23 20.28,35.3 19.03,36.56 17.45,36.56 17.08,36.19 CN3.1
UART7_RX: length 17.4
  Top Layer w0.14: U1.37 30.51,27.56 v1(30.51,28.74)
  Bottom Layer w0.14: v1(30.51,28.74) 30.51,29.4 29.85,30.06 27.77,30.06 26.8,31.03 26.8,33.93 27.71,34.85 30.3,34.85 31.44,33.72 32.69,33.72 33.05,34.07 33.05,35.14 CN4.2
UART7_TX: length 14.8
  Top Layer w0.14: v1(30,29.25) U1.38
  Bottom Layer w0.14: 31.8,35.14 27.59,35.14 26.49,34.04 26.49,30.92 27.71,29.7 29.54,29.7 v1(30,29.25)
USB_D+: length 21.5
  Top Layer w0.14: v1(6.23,20.25) USB1.A6 7.61,20.27 10.62,20.27 14.99,15.91 21,15.91 21.14,16.05 21.43,16.05 21.47,16 U1.71 ; v1(6.23,19.29) 7.55,19.29 USB1.B6
  Bottom Layer w0.14: v1(6.23,19.29) 5.77,19.29 5.56,19.49 5.56,20.05 5.76,20.25 v1(6.23,20.25)
USB_D-: length 21.5
  Top Layer w0.14: USB1.A7 7.54,19.8 5.87,19.8 5.62,20.05 5.62,20.51 5.87,20.76 7.58,20.76 USB1.B7 7.6,20.76 10.54,20.76 15.11,16.2 20.88,16.2 21.13,16.45 21.43,16.45 21.47,16.5 U1.70
VREF: length 11.3
  Top Layer w0.203: U1.20 38.48,23.5 39.14,24.17 39.14,24.93 40.31,26.1 40.31,27.72 40.52,27.93 40.91,27.93 C14.2
  Top Layer w0.254: R1.1 41.19,30.97 C15.2 42.17,29.42 41.99,29.25 41.18,29.25 40.92,28.99 C14.2
$1N1678: length 4.8
  Top Layer w0.14: U1.73 21.39,15 21.16,14.77 C1.1
$1N1681: length 2.6
  Top Layer w0.14: U1.48 25,29.07 25.28,29.35 C2.2
$1N8061: length 6.3
  Top Layer w0.14: Q1.1 15.83,10.04 15.27,10.04 14.61,9.38 13.64,9.38 13.24,9.79 R2.2 R3.2 10.81,10.42 C17.2
$1N8406: length 8.4
  Top Layer w0.14: D2.1 10.02,9.81 10.7,9.13 10.7,8.52 Q2.1 14.69,8.5 14.96,8.77 15.67,8.77 15.83,8.62 C19.2
$1N8466: length 2
  Top Layer w0.14: Q2.3 13.54,7.55 14.05,7.05 14.48,7.05 R5.1
$1N9525: length 7.5
  Top Layer w0.14: R2.1 13.24,11.92 13,12.16 D2.2
  Top Layer w0.152: SW1.2 9.04,12.25 9.04,12.26
$1N18516: length 2.8
  Top Layer w0.14: 9.81,22.11 9.81,21.65 9.41,21.25 USB1.A5
$1N18565: length 2.4
  Top Layer w0.14: USB1.B5 8.74,18.25 9.07,17.92 9.78,17.92 R10.2
$1N50322: length 3.6
  Top Layer w0.14: LED3.2 50.01,6.83 50.01,7.61 50.73,8.32 R28.2
$1N50898: length 3.4
  Top Layer w0.14: LED4.2 51.74,6.83 51.74,7.71 52,7.96 R16.2
$2N794: length 3.7
  Top Layer w0.14: C26.2 25.28,32.55 25.63,32.2 R11.10
$2N2588: length 6.4
  Top Layer w0.14: U5.8 41.53,8.32 42.14,8.32 43.61,6.84 43.61,6.23 43.92,5.93 45.44,5.93 45.67,6.16 ; 45.67,6.16 C29.2
$2N2599: length 5.2
  Top Layer w0.14: C29.1 45.65,8.07 45.65,8.62 45.44,8.82 43.66,8.82 43.16,9.33 43.16,9.89 42.7,10.35 42.04,10.35 U5.12
$2N2763: length 2.8
  Top Layer w0.14: U5.10 42.04,9.33 42.65,9.33 43.93,8.05 C30.1
$2N4523: length 2.4
  Top Layer w0.14: R27.1 25.25,7.1 24.21,7.1 23.66,6.55 R26.9
$3N1353: length 2.3
  Top Layer w0.254: U6.6 11.38,35.75 R19.2
$3N1354: length 2.4
  Top Layer w0.254: C44.2 10.73,35.02 U6.7
$3N1361: length 2.1
  Top Layer w0.254: R20.1 12.03,36.29 12.03,34.29
$3N1362: length 1.3
  Top Layer w0.254: 12.09,37.2 13.25,37.2 13.36,37.31
$3N1363: length 4.2
  Top Layer w0.254: R21.2 R23.2 R22.1 arc(6.92,36.13) 6.89,36.27 C46.1
$4N1181: length 15.2
  Top Layer w0.14: SW3.1 56.44,12.28 52.25,12.28 51.79,11.82 47.02,11.82 46.61,12.23 46.61,12.94 47.32,13.65 49.05,13.65 49.43,14.03 L4.11
$4N1470: length 5.9
  Top Layer w0.14: R25.1 53.27,8.98 52.66,8.37 52.66,5.42 52.86,5.22 53.49,5.22 LED2.1
$4N1612: length 4.2
  Top Layer w0.14: L4.1 57.13,26.61 57.79,27.27 ANT1.2

## Copper pours and planes (outline as drawn; the poured copper is in the pictures)
+5V on Top Layer: 45.19,34.99 48.08,34.99 48.08,32.45 45.19,32.45
+5V on Top Layer: 41.07,36.36 45.8,36.36 45.8,33.97 41.07,33.97
+5V on Top Layer: 14.23,35.88 19.86,35.88 19.86,31.18 14.23,31.18
+5V on Bottom Layer: 43.56,36.36 50.78,36.36 50.78,29.86 43.56,29.86
+5V on PWR: 6.91,38.98 48.92,38.98 48.92,16.62 6.91,16.62
+12V on Top Layer: 10.65,30.01 12.02,30.01 12.02,28.38 10.65,28.38
+12V on Top Layer: 3.41,32.5 10.9,32.5 10.9,28.51 3.41,28.51
+12V on Bottom Layer: 3.41,34.22 8.38,34.22 8.38,28.54 3.41,28.54
GND on Top Layer: -1.14,42.63 61.75,42.63 61.75,-0.91 -1.14,-0.91
GND on Top Layer: 3.22,35.48 12.68,35.48 12.68,30.94 3.22,30.94
GND on Top Layer: 6.33,28.18 11.97,28.18 11.97,25.79 6.33,25.79
GND on Top Layer: 14.2,38.09 20.1,38.09 20.1,36.2 14.2,36.2
GND on Bottom Layer: 51.57,34.17 53.37,34.17 53.37,28.54 51.57,28.54
GND on Bottom Layer: 9,34.53 10.77,34.53 10.77,29.49 9,29.49
GND on Bottom Layer: -4.75,44.44 62.88,44.44 62.88,-2.95 -4.75,-2.95
GND on GND: 1.02,38.98 58.98,38.98 58.98,1.02 1.02,1.02
VCC on Top Layer: 48.9,33.72 54.64,33.72 54.64,29.75 48.9,29.75
VCC on Top Layer: 46.56,31.68 49,31.68 49,29.35 46.56,29.35
VCC on PWR: 1.02,38.98 58.98,38.98 58.98,1.02 1.02,1.02
$1N12306 on Top Layer: 44.53,33.06 45.8,33.06 45.8,29.35 44.53,29.35
$1N12347 on Top Layer: 46.87,34.94 52.15,34.94 52.15,34.02 46.87,34.02
$3N1356 on Top Layer: 11.2,32.45 11.24,32.51 11.52,32.51 11.56,32.45 11.56,31.18 11.81,30.92 12.96,30.92 14.1,29.78 14.1,28 14.86,27.24 18.29,27.24 18.54,26.99 18.54,24.83 18.29,24.57 13.46,24.57 12.32,25.72 12.32,29.32 11.96,29.68 11.5,29.68 11.2,30.01
$3N1356 on Top Layer: 12.71,36.64 14.1,36.64 14.1,29.53 12.71,29.53
$3N1365 on Top Layer: 7.55,34.94 10.29,34.94 10.29,32.9 7.55,32.9

Small or netless copper shapes (teardrops, artwork), in the pictures only: 515 on Top Layer, 112 on Bottom Layer, 8 on GND
